# EasyEDA Pro project kuafu01_030内部老化方案.eprj, board PCB4 (continued)
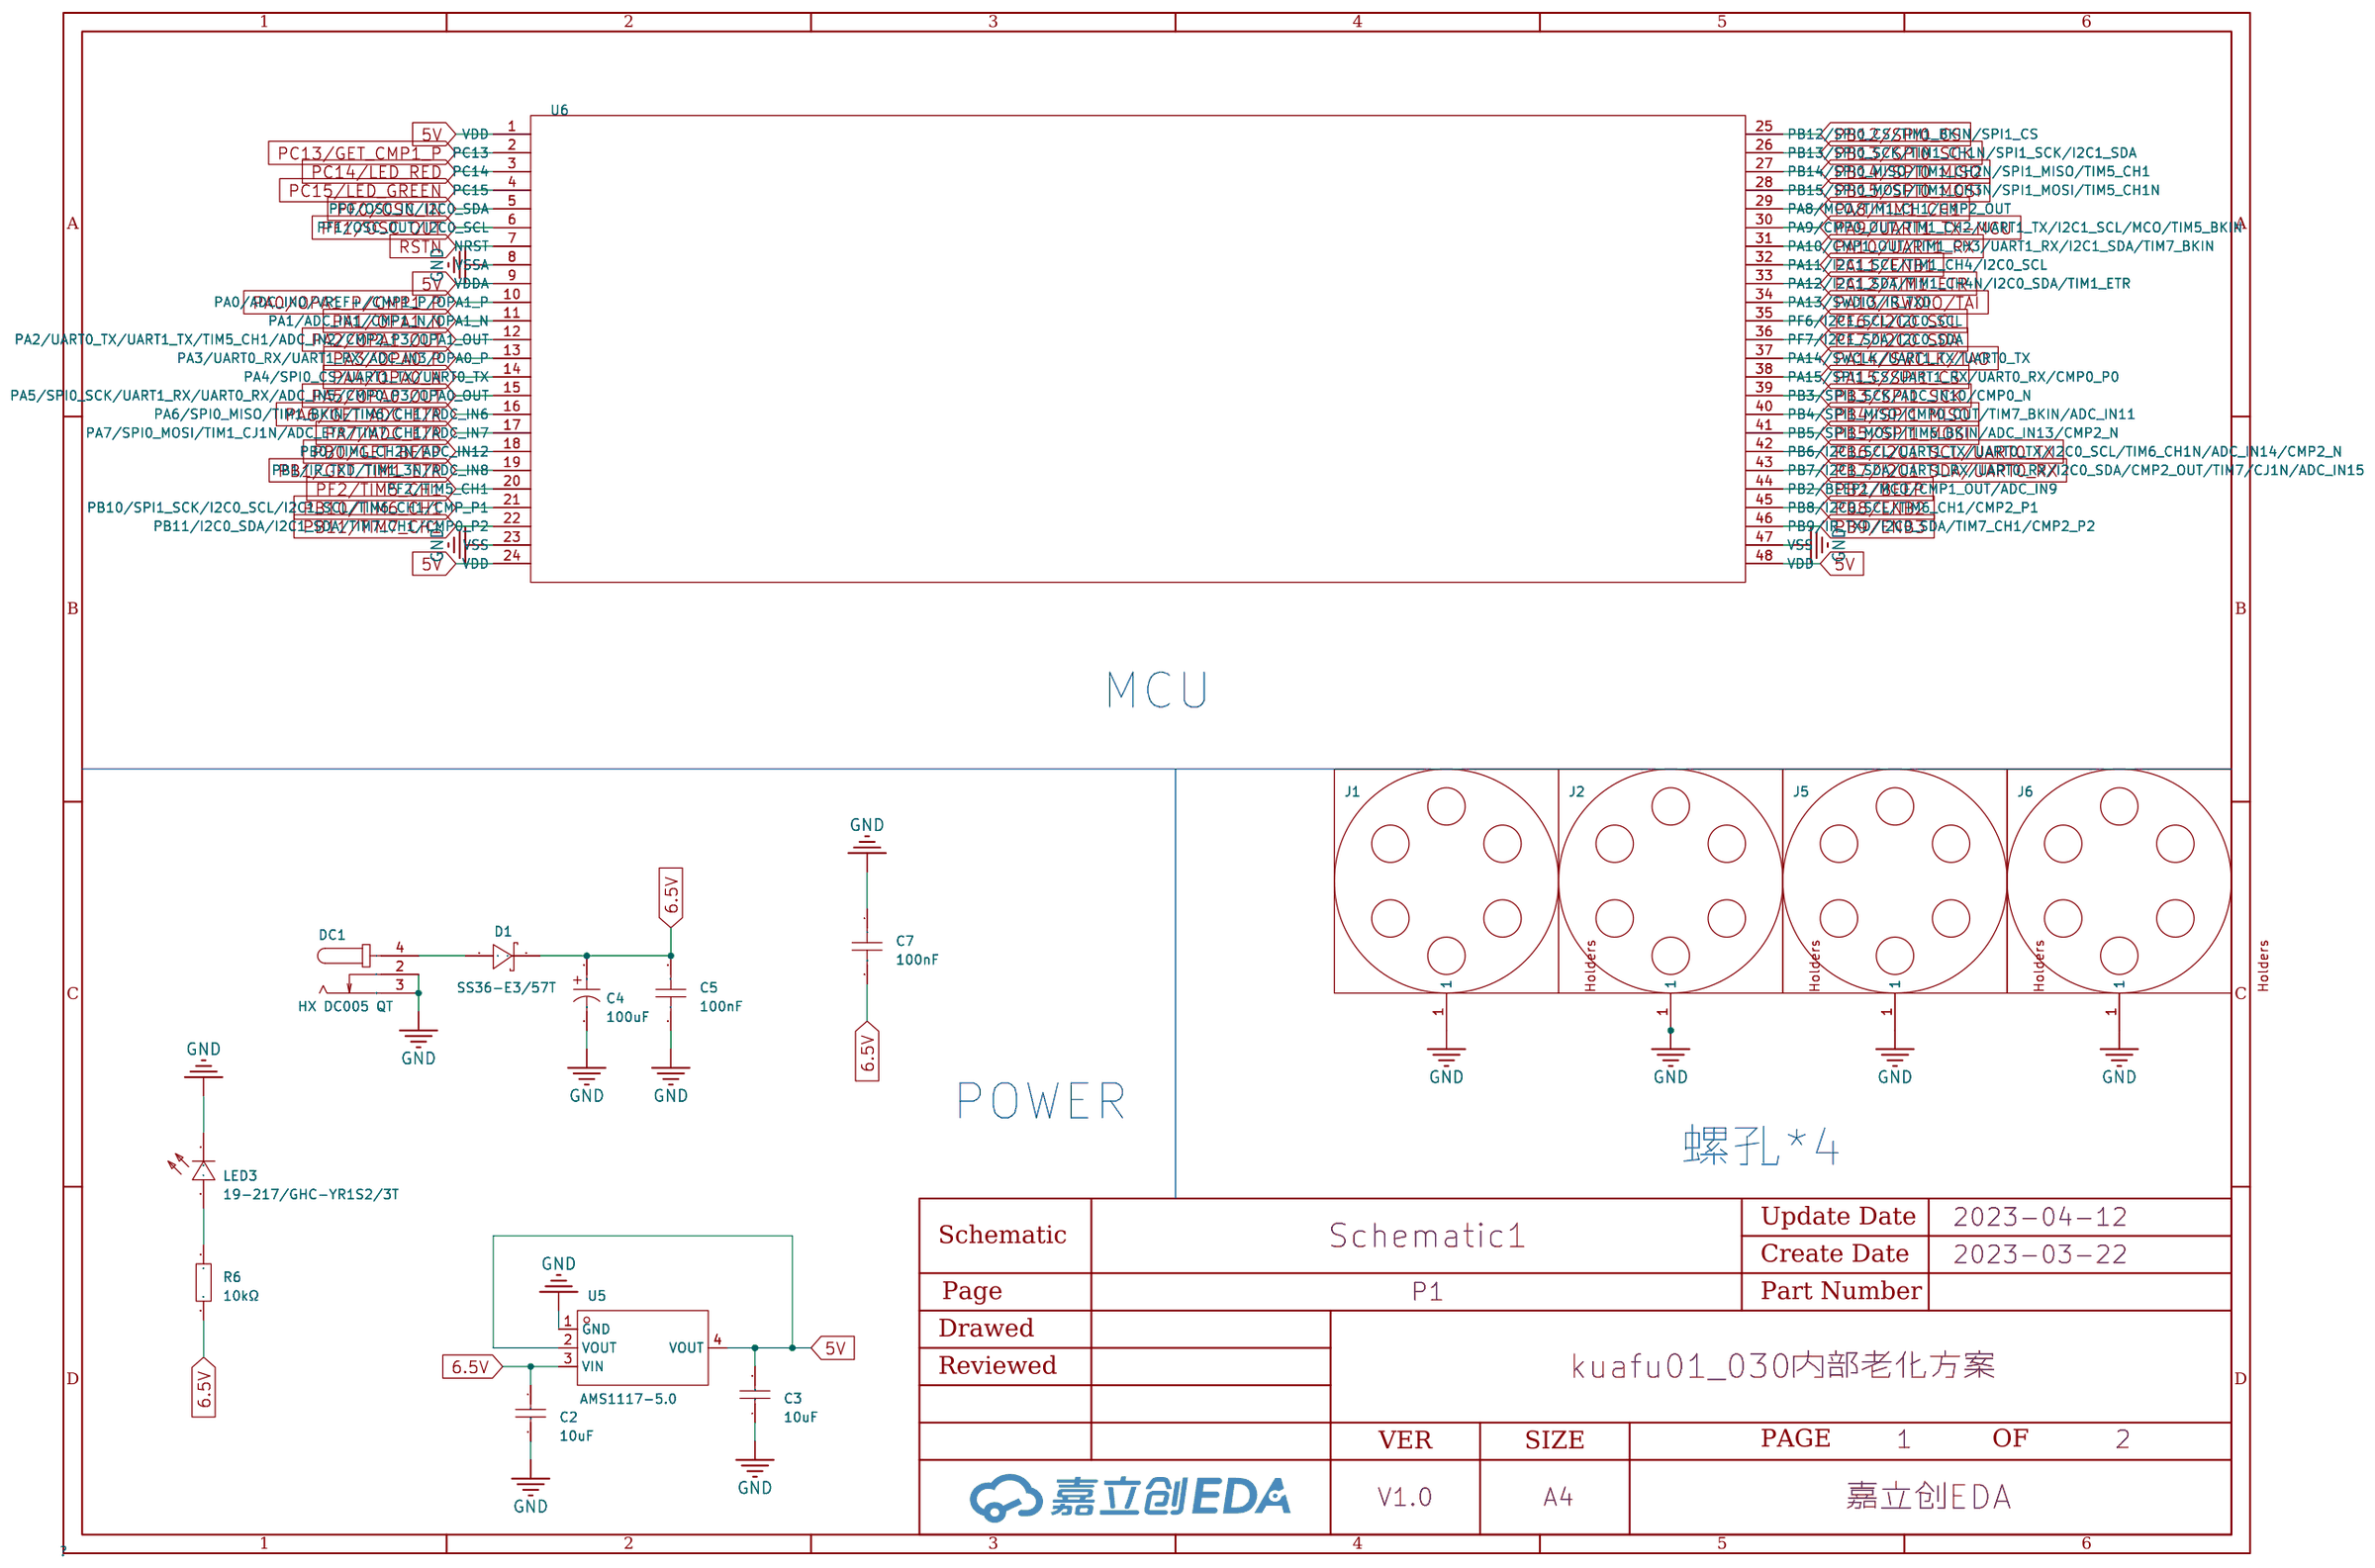
[diagram p0: P1]
## Nets (continued)
$1N1872: D1.1 DC1.4
$1N1886: LED3.2 R6.1
$4N6329: LED2.1 LED2#2.1 LED2#3.1 LED2#4.1 LED2#5.1 LED2#6.1 LED2#7.1 LED2#8.1 LED2#9.1 LED2#10.1 LED2#11.1 LED2#12.1 LED2#13.1 LED2#14.1 LED2#15.1 LED2#16.1 LED2#17.1 LED2#18.1 LED2#19.1 LED2#20.1 LED2#21.1 LED2#22.1 LED2#23.1 LED2#24.1 LED2#25.1 LED2#26.1 LED2#27.1 LED2#28.1 LED2#29.1 LED2#30.1 LED2#31.1 LED2#32.1 LED2#33.1 LED2#34.1 LED2#35.1 LED2#36.1 LED2#37.1 LED2#38.1 LED2#39.1 LED2#40.1 R2.2 R2#2.2 R2#3.2 R2#4.2 R2#5.2 R2#6.2 R2#7.2 R2#8.2 R2#9.2 R2#10.2 R2#11.2 R2#12.2 R2#13.2 R2#14.2 R2#15.2 R2#16.2 R2#17.2 R2#18.2 R2#19.2 R2#20.2 R2#21.2 R2#22.2 R2#23.2 R2#24.2 R2#25.2 R2#26.2 R2#27.2 R2#28.2 R2#29.2 R2#30.2 R2#31.2 R2#32.2 R2#33.2 R2#34.2 R2#35.2 R2#36.2 R2#37.2 R2#38.2 R2#39.2 R2#40.2
$4N6330: LED1.1 LED1#2.1 LED1#3.1 LED1#4.1 LED1#5.1 LED1#6.1 LED1#7.1 LED1#8.1 LED1#9.1 LED1#10.1 LED1#11.1 LED1#12.1 LED1#13.1 LED1#14.1 LED1#15.1 LED1#16.1 LED1#17.1 LED1#18.1 LED1#19.1 LED1#20.1 LED1#21.1 LED1#22.1 LED1#23.1 LED1#24.1 LED1#25.1 LED1#26.1 LED1#27.1 LED1#28.1 LED1#29.1 LED1#30.1 LED1#31.1 LED1#32.1 LED1#33.1 LED1#34.1 LED1#35.1 LED1#36.1 LED1#37.1 LED1#38.1 LED1#39.1 LED1#40.1 R1.2 R1#2.2 R1#3.2 R1#4.2 R1#5.2 R1#6.2 R1#7.2 R1#8.2 R1#9.2 R1#10.2 R1#11.2 R1#12.2 R1#13.2 R1#14.2 R1#15.2 R1#16.2 R1#17.2 R1#18.2 R1#19.2 R1#20.2 R1#21.2 R1#22.2 R1#23.2 R1#24.2 R1#25.2 R1#26.2 R1#27.2 R1#28.2 R1#29.2 R1#30.2 R1#31.2 R1#32.2 R1#33.2 R1#34.2 R1#35.2 R1#36.2 R1#37.2 R1#38.2 R1#39.2 R1#40.2

Pads without a net: U6 49; U6#2 49; U6#3 49; U6#4 49; U6#5 49; U6#6 49; U6#7 49; U6#8 49; U6#9 49; U6#10 49; U6#11 49; U6#12 49; U6#13 49; U6#14 49; U6#15 49; U6#16 49; U6#17 49; U6#18 49; U6#19 49; U6#20 49; U6#21 49; U6#22 49; U6#23 49; U6#24 49; U6#25 49; U6#26 49; U6#27 49; U6#28 49; U6#29 49; U6#30 49; U6#31 49; U6#32 49; U6#33 49; U6#34 49; U6#35 49; U6#36 49; U6#37 49; U6#38 49; U6#39 49; U6#40 49

## Via types
v1: diameter 0.61, hole 0.305, Top Layer to Bottom Layer, 8086 vias

## Routing (per net, layer and track width the routed paths; a pad name or vN(x,y) marks a point on that pad's centre or on a via; arc(x,y) is an arc through that point)
2.048V: length 887.5
  Top Layer w0.254: 250.36,223.31 252.09,225.05 252.09,225.91 ; 250.36,223.31 250.36,220.43 248.09,218.16 ; 250.36,223.31 247.61,223.31 247.57,223.27 ; 201.29,276.71 201.29,275.85 199.56,274.11 ; 137.86,172.49 137.86,173.3 138.81,174.24 144.3,174.24 145.95,172.6 ; 148.76,121.71 150.49,123.45 150.49,124.31 ; 148.76,121.71 148.76,118.83 146.49,116.56 ; 148.76,121.71 146.01,121.71 145.97,121.67 ; 252.09,175.11 252.09,174.25 250.36,172.51 ; 47.16,121.71 47.16,118.83 44.89,116.56 ; 47.16,121.71 44.41,121.71 44.37,121.67 ; 47.16,121.71 48.89,123.45 48.89,124.31 ; 252.09,327.51 252.09,326.65 250.36,324.91 ; 44.37,172.47 44.41,172.51 47.16,172.51 ; 87.06,324.89 87.06,325.7 88,326.64 93.5,326.64 95.15,325 ; 301.16,121.71 302.89,123.45 302.89,124.31 ; 301.16,121.71 298.41,121.71 298.37,121.67 ; 301.16,121.71 301.16,118.83 298.89,116.56 ; 250.36,70.91 247.61,70.91 247.57,70.87 ; 250.36,70.91 250.36,68.03 248.09,65.76 ; 250.36,70.91 252.09,72.65 252.09,73.51 ; 196.75,20.2 195.1,21.84 189.61,21.84 188.66,20.9 188.66,20.09 ; 44.35,121.8 42.7,123.44 37.2,123.44 36.26,122.5 36.26,121.69 ; 201.29,73.51 201.29,72.65 199.56,70.91 ; 87.06,274.09 87.06,274.9 88,275.84 93.5,275.84 95.15,274.2 ; 95.17,121.67 95.21,121.71 97.96,121.71 ; 247.57,172.47 247.61,172.51 250.36,172.51 ; 150.49,225.91 150.49,225.05 148.76,223.31 ; 197.29,268.96 199.56,271.23 199.56,274.11 ; 95.69,268.96 97.96,271.23 97.96,274.11 ; 298.35,274.2 296.7,275.84 291.2,275.84 290.26,274.9 290.26,274.09 ; 97.96,20.11 97.96,17.23 95.69,14.96 ; 97.96,20.11 99.69,21.85 99.69,22.71 ; 97.96,20.11 95.21,20.11 95.17,20.07 ; 97.96,70.91 97.96,68.03 95.69,65.76 ; 97.96,70.91 99.69,72.65 99.69,73.51 ; 97.96,70.91 95.21,70.91 95.17,70.87 ; 298.37,70.87 298.41,70.91 301.16,70.91 ; 148.76,70.91 146.01,70.91 145.97,70.87 ; 148.76,70.91 148.76,68.03 146.49,65.76 ; 148.76,70.91 150.49,72.65 150.49,73.51 ; 47.16,20.11 44.41,20.11 44.37,20.07 ; 47.16,20.11 48.89,21.85 48.89,22.71 ; 47.16,20.11 47.16,17.23 44.89,14.96 ; 44.35,71 42.7,72.64 37.2,72.64 36.26,71.7 36.26,70.89 ; 298.89,65.76 301.16,68.03 301.16,70.91 ; 290.26,70.89 290.26,71.7 291.2,72.64 296.7,72.64 298.35,71 ; 239.46,121.69 239.46,122.5 240.41,123.44 245.9,123.44 247.55,121.8 ; 302.89,175.11 302.89,174.25 301.16,172.51 ; 301.16,324.91 298.41,324.91 298.37,324.87 ; 301.16,324.91 302.89,326.65 302.89,327.51 ; 301.16,324.91 301.16,322.03 298.89,319.76 ; 196.75,71 195.1,72.64 189.61,72.64 188.66,71.7 188.66,70.89 ; 99.69,225.91 99.69,225.05 97.96,223.31 ; 201.29,225.91 201.29,225.05 199.56,223.31 ; 150.49,22.71 150.49,21.85 148.76,20.11 ; 44.37,70.87 44.41,70.91 47.16,70.91 ; 247.57,274.07 247.61,274.11 250.36,274.11 ; 145.95,223.4 144.3,225.04 138.81,225.04 137.86,224.1 137.86,223.29 ; 199.56,121.71 196.81,121.71 196.77,121.67 ; 199.56,121.71 201.29,123.45 201.29,124.31 ; 199.56,121.71 199.56,118.83 197.29,116.56 ; 150.49,175.11 150.49,174.25 148.76,172.51 ; 148.76,20.11 148.76,17.23 146.49,14.96 ; 148.76,20.11 146.01,20.11 145.97,20.07 ; 239.46,324.89 239.46,325.7 240.41,326.64 245.9,326.64 247.55,325 ; 188.66,324.89 188.66,325.7 189.61,326.64 195.1,326.64 196.75,325 ; 197.29,14.96 199.56,17.23 199.56,20.11 ; 148.76,274.11 150.49,275.85 150.49,276.71 ; 148.76,274.11 146.01,274.11 145.97,274.07 ; 148.76,274.11 148.76,271.23 146.49,268.96 ; 97.96,172.51 95.21,172.51 95.17,172.47 ; 97.96,172.51 97.96,169.63 95.69,167.36 ; 97.96,172.51 99.69,174.25 99.69,175.11 ; 301.16,223.31 301.16,220.43 298.89,218.16 ; 301.16,223.31 298.41,223.31 298.37,223.27 ; 301.16,223.31 302.89,225.05 302.89,225.91 ; 290.26,324.89 290.26,325.7 291.2,326.64 296.7,326.64 298.35,325 ; 47.16,172.51 47.16,169.63 44.89,167.36 ; 47.16,172.51 48.89,174.25 48.89,175.11 ; 199.56,324.91 196.81,324.91 196.77,324.87 ; 199.56,324.91 199.56,322.03 197.29,319.76 ; 199.56,324.91 201.29,326.65 201.29,327.51 ; 250.36,274.11 252.09,275.85 252.09,276.71 ; 250.36,274.11 250.36,271.23 248.09,268.96 ; 301.16,172.51 298.41,172.51 298.37,172.47 ; 301.16,172.51 301.16,169.63 298.89,167.36 ; 247.55,172.6 245.9,174.24 240.41,174.24 239.46,173.3 239.46,172.49 ; 146.49,218.16 148.76,220.43 148.76,223.31 ; 290.26,172.49 290.26,173.3 291.2,174.24 296.7,174.24 298.35,172.6 ; 97.96,274.11 95.21,274.11 95.17,274.07 ; 97.96,274.11 99.69,275.85 99.69,276.71 ; 97.96,121.71 97.96,118.83 95.69,116.56 ; 97.96,121.71 99.69,123.45 99.69,124.31 ; 87.06,121.69 87.06,122.5 88,123.44 93.5,123.44 95.15,121.8 ; 250.36,20.11 250.36,17.23 248.09,14.96 ; 250.36,20.11 247.61,20.11 247.57,20.07 ; 250.36,20.11 252.09,21.85 252.09,22.71 ; 248.09,167.36 250.36,169.63 250.36,172.51 ; 301.16,70.91 302.89,72.65 302.89,73.51 ; 188.66,223.29 188.66,224.1 189.61,225.04 195.1,225.04 196.75,223.4 ; 196.75,121.8 195.1,123.44 189.61,123.44 188.66,122.5 188.66,121.69 ; 248.09,116.56 250.36,118.83 250.36,121.71 ; 199.56,172.51 201.29,174.25 201.29,175.11 ; 199.56,172.51 196.81,172.51 196.77,172.47 ; 199.56,172.51 199.56,169.63 197.29,167.36 ; 197.29,65.76 199.56,68.03 199.56,70.91 ; 148.76,223.31 146.01,223.31 145.97,223.27 ; 250.36,121.71 247.61,121.71 247.57,121.67 ; 250.36,121.71 252.09,123.45 252.09,124.31 ; 188.66,172.49 188.66,173.3 189.61,174.24 195.1,174.24 196.75,172.6 ; 301.16,274.11 302.89,275.85 302.89,276.71 ; 301.16,274.11 298.41,274.11 298.37,274.07 ; 301.16,274.11 301.16,271.23 298.89,268.96 ; 196.77,223.27 196.81,223.31 199.56,223.31 ; 97.96,223.31 97.96,220.43 95.69,218.16 ; 97.96,223.31 95.21,223.31 95.17,223.27 ; 199.56,223.31 199.56,220.43 197.29,218.16 ; 97.96,324.91 99.69,326.65 99.69,327.51 ; 97.96,324.91 95.21,324.91 95.17,324.87 ; 97.96,324.91 97.96,322.03 95.69,319.76 ; 145.97,172.47 146.01,172.51 148.76,172.51 ; 44.89,218.16 47.16,220.43 47.16,223.31 ; 148.76,324.91 150.49,326.65 150.49,327.51 ; 148.76,324.91 146.01,324.91 145.97,324.87 ; 148.76,324.91 148.76,322.03 146.49,319.76 ; 47.16,70.91 48.89,72.65 48.89,73.51 ; 47.16,70.91 47.16,68.03 44.89,65.76 ; 95.15,172.6 93.5,174.24 88,174.24 87.06,173.3 87.06,172.49 ; 44.35,274.2 42.7,275.84 37.2,275.84 36.26,274.9 36.26,274.09 ; 247.55,274.2 245.9,275.84 240.41,275.84 239.46,274.9 239.46,274.09 ; 199.56,70.91 196.81,70.91 196.77,70.87 ; 47.16,274.11 48.89,275.85 48.89,276.71 ; 47.16,274.11 47.16,271.23 44.89,268.96 ; 47.16,274.11 44.41,274.11 44.37,274.07 ; 146.49,167.36 148.76,169.63 148.76,172.51 ; 250.36,324.91 250.36,322.03 248.09,319.76 ; 250.36,324.91 247.61,324.91 247.57,324.87 ; 199.56,274.11 196.81,274.11 196.77,274.07 ; 196.77,20.07 196.81,20.11 199.56,20.11 ; 87.06,20.09 87.06,20.9 88,21.84 93.5,21.84 95.15,20.2 ; 298.35,121.8 296.7,123.44 291.2,123.44 290.26,122.5 290.26,121.69 ; 247.55,223.4 245.9,225.04 240.41,225.04 239.46,224.1 239.46,223.29 ; 137.86,324.89 137.86,325.7 138.81,326.64 144.3,326.64 145.95,325 ; 145.95,121.8 144.3,123.44 138.81,123.44 137.86,122.5 137.86,121.69 ; 36.26,223.29 36.26,224.1 37.2,225.04 42.7,225.04 44.35,223.4 ; 47.16,223.31 48.89,225.05 48.89,225.91 ; 47.16,223.31 44.41,223.31 44.37,223.27 ; 95.15,71 93.5,72.64 88,72.64 87.06,71.7 87.06,70.89 ; 199.56,20.11 201.29,21.85 201.29,22.71 ; 298.35,223.4 296.7,225.04 291.2,225.04 290.26,224.1 290.26,223.29 ; 239.46,70.89 239.46,71.7 240.41,72.64 245.9,72.64 247.55,71 ; 145.95,20.2 144.3,21.84 138.81,21.84 137.86,20.9 137.86,20.09 ; 44.35,172.6 42.7,174.24 37.2,174.24 36.26,173.3 36.26,172.49 ; 137.86,274.09 137.86,274.9 138.81,275.84 144.3,275.84 145.95,274.2 ; 36.26,20.09 36.26,20.9 37.2,21.84 42.7,21.84 44.35,20.2 ; 247.55,20.2 245.9,21.84 240.41,21.84 239.46,20.9 239.46,20.09 ; 95.15,223.4 93.5,225.04 88,225.04 87.06,224.1 87.06,223.29 ; 188.66,274.09 188.66,274.9 189.61,275.84 195.1,275.84 196.75,274.2 ; 145.95,71 144.3,72.64 138.81,72.64 137.86,71.7 137.86,70.89
5V: length 9500
  Top Layer w0.381: 300.69,228.71 296.87,228.71 294.88,226.72 291.99,226.72 v1(291.42,226.14) ; 96.69,31.83 96.33,32.19 96.33,32.9 ; 96.69,31.83 95.2,31.83 93.57,33.46 v1(93.57,34.25) ; 96.69,31.83 97.62,30.9 ; 46.82,284.9 47.45,285.53 48.8,285.53 ; 46.82,284.9 45.89,285.83 ; 46.82,284.9 46.82,283.59 46.85,283.57 ; v1(189.82,73.74) 190.39,74.32 193.28,74.32 195.27,76.31 199.09,76.31 ; 96.69,82.63 96.33,82.99 96.33,83.7 ; 96.69,82.63 95.2,82.63 93.57,84.26 v1(93.57,85.05) ; 96.69,82.63 97.62,81.7 ; v1(245.97,34.25) 245.97,33.46 247.6,31.83 249.09,31.83 ; v1(139.02,22.94) 139.59,23.52 142.48,23.52 144.47,25.51 148.29,25.51 ; 299.53,83.7 299.53,82.99 299.89,82.63 ; 97.62,30.9 97.62,29.59 97.65,29.57 ; 97.62,30.9 98.25,31.53 99.6,31.53 ; v1(55.2,172.64) 54.39,173.45 54.39,174.97 ; v1(139.02,327.74) 139.59,328.32 142.48,328.32 144.47,330.31 148.29,330.31 ; 97.62,81.7 98.25,82.33 99.6,82.33 ; 97.62,81.7 97.62,80.39 97.65,80.37 ; 155.99,225.77 155.99,224.25 v1(156.8,223.44) ; v1(144.37,339.05) 144.37,338.26 146,336.63 147.49,336.63 ; 155.8,39 156.89,40.1 v1(156.92,40.1) ; 197.93,286.9 197.93,286.19 198.29,285.83 ; 299.89,133.43 300.82,132.5 ; 299.89,133.43 298.4,133.43 296.77,135.06 v1(296.77,135.85) ; 299.89,133.43 299.53,133.79 299.53,134.5 ; 300.82,132.5 301.45,133.13 302.8,133.13 ; 300.82,132.5 300.82,131.19 300.85,131.17 ; v1(156.8,121.84) 155.99,122.65 155.99,124.17 ; 148.45,29.57 148.42,29.59 148.42,30.9 ; 99.6,183.93 98.25,183.93 97.62,183.3 ; 96.69,285.83 95.2,285.83 93.57,287.46 v1(93.57,288.25) ; 96.69,285.83 96.33,286.19 96.33,286.9 ; 96.69,285.83 97.62,284.9 ; 299.89,235.03 298.4,235.03 296.77,236.66 v1(296.77,237.45) ; 299.89,235.03 300.82,234.1 ; 299.89,235.03 299.53,235.39 299.53,236.1 ; 96.69,184.23 96.33,184.59 96.33,185.3 ; 96.69,184.23 95.2,184.23 93.57,185.86 v1(93.57,186.65) ; 96.69,184.23 97.62,183.3 ; 199.22,234.1 199.22,232.79 199.25,232.77 ; 199.22,234.1 199.85,234.73 201.2,234.73 ; 199.22,234.1 198.29,235.03 ; 148.42,132.5 149.05,133.13 150.4,133.13 ; 148.42,132.5 148.42,131.19 148.45,131.17 ; 148.42,132.5 147.49,133.43 ; 45.89,82.63 46.82,81.7 ; 45.89,82.63 45.53,82.99 45.53,83.7 ; 45.89,82.63 44.4,82.63 42.77,84.26 v1(42.77,85.05) ; 46.82,81.7 47.45,82.33 48.8,82.33 ; 46.82,81.7 46.82,80.39 46.85,80.37 ; 96.33,134.5 96.33,133.79 96.69,133.43 ; v1(37.42,22.94) 37.99,23.52 40.88,23.52 42.87,25.51 46.69,25.51 ; 250.02,284.9 250.02,283.59 250.05,283.57 ; 250.02,284.9 249.09,285.83 ; 250.02,284.9 250.65,285.53 252,285.53 ; 147.49,82.63 148.42,81.7 ; 147.49,82.63 147.13,82.99 147.13,83.7 ; 147.49,82.63 146,82.63 144.37,84.26 v1(144.37,85.05) ; 148.42,81.7 148.42,80.39 148.45,80.37 ; 148.42,81.7 149.05,82.33 150.4,82.33 ; 257.4,89.8 258.49,90.9 v1(258.52,90.9) ; 147.49,285.83 147.13,286.19 147.13,286.9 ; 147.49,285.83 146,285.83 144.37,287.46 v1(144.37,288.25) ; 147.49,285.83 148.42,284.9 ; 147.49,31.83 147.13,32.19 147.13,32.9 ; 147.49,31.83 146,31.83 144.37,33.46 v1(144.37,34.25) ; 147.49,31.83 148.42,30.9 ; 249.89,177.91 246.07,177.91 244.08,175.92 241.19,175.92 v1(240.62,175.34) ; 155.8,191.4 156.89,192.5 v1(156.92,192.5) ; 300.82,81.7 300.82,80.39 300.85,80.37 ; 300.82,81.7 299.89,82.63 ; 300.82,81.7 301.45,82.33 302.8,82.33 ; 249.09,235.03 250.02,234.1 ; 249.09,235.03 248.73,235.39 248.73,236.1 ; 249.09,235.03 247.6,235.03 245.97,236.66 v1(245.97,237.45) ; 250.02,234.1 250.65,234.73 252,234.73 ; 250.02,234.1 250.02,232.79 250.05,232.77 ; v1(207.6,172.64) 206.79,173.45 206.79,174.97 ; 147.13,134.5 147.13,133.79 147.49,133.43 ; 198.29,285.83 199.22,284.9 ; 198.29,285.83 196.8,285.83 195.17,287.46 v1(195.17,288.25) ; 199.22,284.9 199.85,285.53 201.2,285.53 ; 199.22,284.9 199.22,283.59 199.25,283.57 ; 54.2,39 55.29,40.1 v1(55.32,40.1) ; 54.2,293 55.29,294.1 v1(55.32,294.1) ; 257.4,140.6 258.49,141.7 v1(258.52,141.7) ; v1(37.42,73.74) 37.99,74.32 40.88,74.32 42.87,76.31 46.69,76.31 ; v1(240.62,327.74) 241.19,328.32 244.08,328.32 246.07,330.31 249.89,330.31 ; 148.45,232.77 148.42,232.79 148.42,234.1 ; v1(55.32,141.7) 55.29,141.7 54.2,140.6 ; 211.57,132.42 210.83,132.42 210.09,133.16 v1(210.02,133.16) ; 160.77,132.42 160.03,132.42 159.29,133.16 v1(159.22,133.16) ; v1(195.17,237.45) 195.17,236.66 196.8,235.03 198.29,235.03 ; 257.59,73.37 257.59,71.85 v1(258.4,71.04) ; 198.29,336.63 196.8,336.63 195.17,338.26 v1(195.17,339.05) ; 198.29,336.63 199.22,335.7 ; 198.29,336.63 197.93,336.99 197.93,337.7 ; 249.09,336.63 248.73,336.99 248.73,337.7 ; 249.09,336.63 250.02,335.7 ; 249.09,336.63 247.6,336.63 245.97,338.26 v1(245.97,339.05) ; 199.22,132.5 199.85,133.13 201.2,133.13 ; 199.22,132.5 199.22,131.19 199.25,131.17 ; 199.22,132.5 198.29,133.43 ; 250.02,335.7 250.02,334.39 250.05,334.37 ; 250.02,335.7 250.65,336.33 252,336.33 ; 308.2,242.2 309.29,243.3 v1(309.32,243.3) ; 206.79,276.57 206.79,275.05 v1(207.6,274.24) ; 250.02,30.9 250.02,29.59 250.05,29.57 ; 250.02,30.9 250.65,31.53 252,31.53 ; 250.02,30.9 249.09,31.83 ; 46.82,132.5 46.82,131.19 46.85,131.17 ; 46.82,132.5 47.45,133.13 48.8,133.13 ; 46.82,132.5 45.89,133.43 ; 97.49,279.51 93.67,279.51 91.68,277.52 88.79,277.52 v1(88.22,276.94) ; v1(106.12,141.7) 106.09,141.7 105,140.6 ; 249.09,82.63 250.02,81.7 ; 249.09,82.63 248.73,82.99 248.73,83.7 ; 249.09,82.63 247.6,82.63 245.97,84.26 v1(245.97,85.05) ; 250.02,81.7 250.65,82.33 252,82.33 ; 250.02,81.7 250.02,80.39 250.05,80.37 ; 150.4,234.73 149.05,234.73 148.42,234.1 ; 257.4,293 258.49,294.1 v1(258.52,294.1) ; 48.8,31.53 47.45,31.53 46.82,30.9 ; v1(156.92,344.9) 156.89,344.9 155.8,343.8 ; 46.82,30.9 46.82,29.59 46.85,29.57 ; 46.82,30.9 45.89,31.83 ; 105.19,73.37 105.19,71.85 v1(106,71.04) ; 147.49,235.03 147.13,235.39 147.13,236.1 ; 147.49,235.03 148.42,234.1 ; 147.49,235.03 146,235.03 144.37,236.66 v1(144.37,237.45) ; 45.89,31.83 45.53,32.19 45.53,32.9 ; 45.89,31.83 44.4,31.83 42.77,33.46 v1(42.77,34.25) ; 97.65,232.77 97.62,232.79 97.62,234.1 ; 54.2,191.4 55.29,192.5 v1(55.32,192.5) ; v1(189.82,124.54) 190.39,125.12 193.28,125.12 195.27,127.11 199.09,127.11 ; 97.49,25.51 93.67,25.51 91.68,23.52 88.79,23.52 v1(88.22,22.94) ; 299.89,336.63 300.82,335.7 ; 299.89,336.63 298.4,336.63 296.77,338.26 v1(296.77,339.05) ; 299.89,336.63 299.53,336.99 299.53,337.7 ; 300.82,335.7 300.82,334.39 300.85,334.37 ; 300.82,335.7 301.45,336.33 302.8,336.33 ; v1(106,121.84) 105.19,122.65 105.19,124.17 ; v1(309.2,274.24) 308.39,275.05 308.39,276.57 ; v1(207.6,71.04) 206.79,71.85 206.79,73.37 ; v1(159.22,285.56) 159.29,285.56 160.03,284.82 160.77,284.82 ; v1(156.8,172.64) 155.99,173.45 155.99,174.97 ; 105,39 106.09,40.1 v1(106.12,40.1) ; 302.8,285.53 301.45,285.53 300.82,284.9 ; 262.37,30.82 261.63,30.82 260.89,31.56 v1(260.82,31.56) ; v1(258.4,20.24) 257.59,21.05 257.59,22.57 ; 109.97,81.62 109.23,81.62 108.49,82.36 v1(108.42,82.36) ; 46.82,183.3 46.82,181.99 46.85,181.97 ; 46.82,183.3 45.89,184.23 ; 46.82,183.3 47.45,183.93 48.8,183.93 ; 148.42,284.9 148.42,283.59 148.45,283.57 ; 148.42,284.9 149.05,285.53 150.4,285.53 ; v1(42.77,186.65) 42.77,185.86 44.4,184.23 45.89,184.23 ; v1(309.2,172.64) 308.39,173.45 308.39,174.97 ; 45.89,235.03 44.4,235.03 42.77,236.66 v1(42.77,237.45) ; 45.89,235.03 46.82,234.1 ; 45.89,235.03 45.53,235.39 45.53,236.1 ; v1(207.6,20.24) 206.79,21.05 206.79,22.57 ; v1(93.57,237.45) 93.57,236.66 95.2,235.03 96.69,235.03 ; v1(189.82,276.94) 190.39,277.52 193.28,277.52 195.27,279.51 199.09,279.51 ; 96.69,336.63 95.2,336.63 93.57,338.26 v1(93.57,339.05) ; 96.69,336.63 97.62,335.7 ; 96.69,336.63 96.33,336.99 96.33,337.7 ; 199.22,30.9 199.85,31.53 201.2,31.53 ; 199.22,30.9 199.22,29.59 199.25,29.57 ; 199.22,30.9 198.29,31.83 ; 147.49,184.23 148.42,183.3 ; 147.49,184.23 146,184.23 144.37,185.86 v1(144.37,186.65) ; 147.49,184.23 147.13,184.59 147.13,185.3 ; 148.42,183.3 149.05,183.93 150.4,183.93 ; 148.42,183.3 148.42,181.99 148.45,181.97 ; 46.69,279.51 42.87,279.51 40.88,277.52 37.99,277.52 v1(37.42,276.94) ; 249.09,285.83 247.6,285.83 245.97,287.46 v1(245.97,288.25) ; 249.09,285.83 248.73,286.19 248.73,286.9 ; 105,191.4 106.09,192.5 v1(106.12,192.5) ; v1(207.72,192.5) 207.69,192.5 206.6,191.4 ; 308.39,327.37 308.39,325.85 v1(309.2,325.04) ; v1(240.62,73.74) 241.19,74.32 244.08,74.32 246.07,76.31 249.89,76.31 ; 59.17,284.82 58.43,284.82 57.69,285.56 v1(57.62,285.56) ; v1(139.02,73.74) 139.59,74.32 142.48,74.32 144.47,76.31 148.29,76.31 ; v1(260.82,285.56) 260.89,285.56 261.63,284.82 262.37,284.82 ; 248.73,32.9 248.73,32.19 249.09,31.83 ; v1(311.62,183.96) 311.69,183.96 312.43,183.22 313.17,183.22 ; 105,293 106.09,294.1 v1(106.12,294.1) ; 250.02,183.3 250.02,181.99 250.05,181.97 ; 250.02,183.3 250.65,183.93 252,183.93 ; 250.02,183.3 249.09,184.23 ; v1(260.82,133.16) 260.89,133.16 261.63,132.42 262.37,132.42 ; 160.77,234.02 160.03,234.02 159.29,234.76 v1(159.22,234.76) ; v1(55.2,223.44) 54.39,224.25 54.39,225.77 ; v1(139.02,226.14) 139.59,226.72 142.48,226.72 144.47,228.71 148.29,228.71 ; v1(245.97,135.85) 245.97,135.06 247.6,133.43 249.09,133.43 ; 313.17,234.02 312.43,234.02 311.69,234.76 v1(311.62,234.76) ; 105,89.8 106.09,90.9 v1(106.12,90.9) ; v1(207.6,121.84) 206.79,122.65 206.79,124.17 ; v1(240.62,276.94) 241.19,277.52 244.08,277.52 246.07,279.51 249.89,279.51 ; 105.19,327.37 105.19,325.85 v1(106,325.04) ; 197.93,236.1 197.93,235.39 198.29,235.03 ; 206.6,242.2 207.69,243.3 v1(207.72,243.3) ; 313.17,284.82 312.43,284.82 311.69,285.56 v1(311.62,285.56) ; 155.99,276.57 155.99,275.05 v1(156.8,274.24) ; v1(207.72,141.7) 207.69,141.7 206.6,140.6 ; v1(156.8,71.04) 155.99,71.85 155.99,73.37 ; v1(291.42,73.74) 291.99,74.32 294.88,74.32 296.87,76.31 300.69,76.31 ; 198.29,184.23 197.93,184.59 197.93,185.3 ; 198.29,184.23 199.22,183.3 ; 198.29,184.23 196.8,184.23 195.17,185.86 v1(195.17,186.65) ; 300.69,330.31 296.87,330.31 294.88,328.32 291.99,328.32 v1(291.42,327.74) ; 300.82,284.9 300.82,283.59 300.85,283.57 ; 300.82,284.9 299.89,285.83 ; v1(291.42,276.94) 291.99,277.52 294.88,277.52 296.87,279.51 300.69,279.51 ; 45.89,133.43 45.53,133.79 45.53,134.5 ; 45.89,133.43 44.4,133.43 42.77,135.06 v1(42.77,135.85) ; 249.89,25.51 246.07,25.51 244.08,23.52 241.19,23.52 v1(240.62,22.94) ; 97.62,284.9 98.25,285.53 99.6,285.53 ; 97.62,284.9 97.62,283.59 97.65,283.57 ; v1(210.02,183.96) 210.09,183.96 210.83,183.22 211.57,183.22 ; 299.89,285.83 299.53,286.19 299.53,286.9 ; 299.89,285.83 298.4,285.83 296.77,287.46 v1(296.77,288.25) ; v1(156.8,20.24) 155.99,21.05 155.99,22.57 ; v1(260.82,82.36) 260.89,82.36 261.63,81.62 262.37,81.62 ; 300.82,234.1 300.82,232.79 300.85,232.77 ; 300.82,234.1 301.45,234.73 302.8,234.73 ; 257.4,242.2 258.49,243.3 v1(258.52,243.3) ; v1(106,172.64) 105.19,173.45 105.19,174.97 ; 45.89,285.83 44.4,285.83 42.77,287.46 v1(42.77,288.25) ; 45.89,285.83 45.53,286.19 45.53,286.9 ; 97.49,76.31 93.67,76.31 91.68,74.32 88.79,74.32 v1(88.22,73.74) ; 257.59,276.57 257.59,275.05 v1(258.4,274.24) ; v1(57.62,234.76) 57.69,234.76 58.43,234.02 59.17,234.02 ; 97.62,234.1 98.25,234.73 99.6,234.73 ; 97.62,234.1 96.69,235.03 ; 147.13,337.7 147.13,336.99 147.49,336.63 ; 59.17,81.62 58.43,81.62 57.69,82.36 v1(57.62,82.36) ; 299.89,184.23 299.53,184.59 299.53,185.3 ; 299.89,184.23 300.82,183.3 ; 299.89,184.23 298.4,184.23 296.77,185.86 v1(296.77,186.65) ; 257.59,124.17 257.59,122.65 v1(258.4,121.84) ; 105.19,22.57 105.19,21.05 v1(106,20.24) ; 257.59,174.97 257.59,173.45 v1(258.4,172.64) ; v1(189.82,175.34) 190.39,175.92 193.28,175.92 195.27,177.91 199.09,177.91 ; 198.29,82.63 199.22,81.7 ; 198.29,82.63 196.8,82.63 195.17,84.26 v1(195.17,85.05) ; 198.29,82.63 197.93,82.99 197.93,83.7 ; 199.22,81.7 199.22,80.39 199.25,80.37 ; 199.22,81.7 199.85,82.33 201.2,82.33 ; 45.89,184.23 45.53,184.59 45.53,185.3 ; 59.17,30.82 58.43,30.82 57.69,31.56 v1(57.62,31.56) ; v1(309.32,294.1) 309.29,294.1 308.2,293 ; v1(311.62,82.36) 311.69,82.36 312.43,81.62 313.17,81.62 ; 206.79,327.37 206.79,325.85 v1(207.6,325.04) ; v1(309.32,344.9) 309.29,344.9 308.2,343.8 ; 198.29,31.83 197.93,32.19 197.93,32.9 ; 198.29,31.83 196.8,31.83 195.17,33.46 v1(195.17,34.25) ; v1(88.22,175.34) 88.79,175.92 91.68,175.92 93.67,177.91 97.49,177.91 ; 299.89,82.63 298.4,82.63 296.77,84.26 v1(296.77,85.05) ; 48.8,234.73 47.45,234.73 46.82,234.1 ; 199.22,183.3 199.22,181.99 199.25,181.97 ; 199.22,183.3 199.85,183.93 201.2,183.93 ; 46.69,177.91 42.87,177.91 40.88,175.92 37.99,175.92 v1(37.42,175.34) ; 308.39,73.37 308.39,71.85 v1(309.2,71.04) ; v1(106,274.24) 105.19,275.05 105.19,276.57 ; 109.97,335.62 109.23,335.62 108.49,336.36 v1(108.42,336.36) ; 257.4,343.8 258.49,344.9 v1(258.52,344.9) ; 262.37,183.22 261.63,183.22 260.89,183.96 v1(260.82,183.96) ; 54.39,276.57 54.39,275.05 v1(55.2,274.24) ; v1(311.62,336.36) 311.69,336.36 312.43,335.62 313.17,335.62 ; 257.59,225.77 257.59,224.25 v1(258.4,223.44) ; v1(57.62,133.16) 57.69,133.16 58.43,132.42 59.17,132.42 ; 109.97,30.82 109.23,30.82 108.49,31.56 v1(108.42,31.56) ; 147.49,133.43 146,133.43 144.37,135.06 v1(144.37,135.85) ; v1(240.62,226.14) 241.19,226.72 244.08,226.72 246.07,228.71 249.89,228.71 ; 109.97,183.22 109.23,183.22 108.49,183.96 v1(108.42,183.96) ; v1(245.97,186.65) 245.97,185.86 247.6,184.23 249.09,184.23 ; 155.99,327.37 155.99,325.85 v1(156.8,325.04) ; 160.77,30.82 160.03,30.82 159.29,31.56 v1(159.22,31.56) ; v1(210.02,82.36) 210.09,82.36 210.83,81.62 211.57,81.62 ; 46.69,127.11 42.87,127.11 40.88,125.12 37.99,125.12 v1(37.42,124.54) ; 197.93,134.5 197.93,133.79 198.29,133.43 ; 199.25,334.37 199.22,334.39 199.22,335.7 ; 249.09,133.43 250.02,132.5 ; 249.09,133.43 248.73,133.79 248.73,134.5 ; v1(207.6,223.44) 206.79,224.25 206.79,225.77 ; v1(210.02,234.76) 210.09,234.76 210.83,234.02 211.57,234.02 ; 46.82,234.1 46.82,232.79 46.85,232.77 ; 252,133.13 250.65,133.13 250.02,132.5 ; v1(189.82,22.94) 190.39,23.52 193.28,23.52 195.27,25.51 199.09,25.51 ; 46.69,228.71 42.87,228.71 40.88,226.72 37.99,226.72 v1(37.42,226.14) ; v1(260.82,234.76) 260.89,234.76 261.63,234.02 262.37,234.02 ; 262.37,335.62 261.63,335.62 260.89,336.36 v1(260.82,336.36) ; 54.39,73.37 54.39,71.85 v1(55.2,71.04) ; 96.69,133.43 97.62,132.5 ; 96.69,133.43 95.2,133.43 93.57,135.06 v1(93.57,135.85) ; 97.62,132.5 97.62,131.19 97.65,131.17 ; 97.62,132.5 98.25,133.13 99.6,133.13 ; v1(291.42,175.34) 291.99,175.92 294.88,175.92 296.87,177.91 300.69,177.91 ; 105,242.2 106.09,243.3 v1(106.12,243.3) ; v1(55.32,243.3) 55.29,243.3 54.2,242.2 ; 109.97,284.82 109.23,284.82 108.49,285.56 v1(108.42,285.56) ; 250.02,132.5 250.02,131.19 250.05,131.17 ; 308.2,191.4 309.29,192.5 v1(309.32,192.5) ; v1(55.32,90.9) 55.29,90.9 54.2,89.8 ; 199.22,335.7 199.85,336.33 201.2,336.33 ; 150.4,31.53 149.05,31.53 148.42,30.9 ; 97.62,335.7 98.25,336.33 99.6,336.33 ; 97.62,335.7 97.62,334.39 97.65,334.37 ; 313.17,132.42 312.43,132.42 311.69,133.16 v1(311.62,133.16) ; 308.2,140.6 309.29,141.7 v1(309.32,141.7) ; 199.09,330.31 195.27,330.31 193.28,328.32 190.39,328.32 v1(189.82,327.74) ; 97.49,228.71 93.67,228.71 91.68,226.72 88.79,226.72 v1(88.22,226.14) ; 109.97,234.02 109.23,234.02 108.49,234.76 v1(108.42,234.76) ; 148.45,334.37 148.42,334.39 148.42,335.7 ; 97.65,181.97 97.62,181.99 97.62,183.3 ; v1(291.42,124.54) 291.99,125.12 294.88,125.12 296.87,127.11 300.69,127.11 ; v1(207.72,294.1) 207.69,294.1 206.6,293 ; 211.57,335.62 210.83,335.62 210.09,336.36 v1(210.02,336.36) ; 248.73,185.3 248.73,184.59 249.09,184.23 ; 147.49,336.63 148.42,335.7 ; 148.42,335.7 149.05,336.33 150.4,336.33 ; 160.77,81.62 160.03,81.62 159.29,82.36 v1(159.22,82.36) ; 155.8,140.6 156.89,141.7 v1(156.92,141.7) ; 97.49,127.11 93.67,127.11 91.68,125.12 88.79,125.12 v1(88.22,124.54) ; v1(156.92,243.3) 156.89,243.3 155.8,242.2 ; 300.82,183.3 301.45,183.93 302.8,183.93 ; 300.82,183.3 300.82,181.99 300.85,181.97 ; 105,343.8 106.09,344.9 v1(106.12,344.9) ; v1(258.4,325.04) 257.59,325.85 257.59,327.37 ; v1(156.92,90.9) 156.89,90.9 155.8,89.8 ; 257.4,39 258.49,40.1 v1(258.52,40.1) ; 211.57,284.82 210.83,284.82 210.09,285.56 v1(210.02,285.56) ; v1(88.22,327.74) 88.79,328.32 91.68,328.32 93.67,330.31 97.49,330.31 ; 206.6,89.8 207.69,90.9 v1(207.72,90.9) ; 198.29,133.43 196.8,133.43 195.17,135.06 v1(195.17,135.85) ; v1(106,223.44) 105.19,224.25 105.19,225.77 ; 308.39,225.77 308.39,224.25 v1(309.2,223.44) ; 109.97,132.42 109.23,132.42 108.49,133.16 v1(108.42,133.16) ; 206.6,39 207.69,40.1 v1(207.72,40.1) ; v1(207.72,344.9) 207.69,344.9 206.6,343.8 ; 199.09,228.71 195.27,228.71 193.28,226.72 190.39,226.72 v1(189.82,226.14) ; 160.77,335.62 160.03,335.62 159.29,336.36 v1(159.22,336.36) ; 59.17,183.22 58.43,183.22 57.69,183.96 v1(57.62,183.96) ; 257.4,191.4 258.49,192.5 v1(258.52,192.5) ; 308.2,89.8 309.29,90.9 v1(309.32,90.9) ; 148.29,177.91 144.47,177.91 142.48,175.92 139.59,175.92 v1(139.02,175.34) ; 148.29,279.51 144.47,279.51 142.48,277.52 139.59,277.52 v1(139.02,276.94) ; v1(156.92,294.1) 156.89,294.1 155.8,293 ; 148.29,127.11 144.47,127.11 142.48,125.12 139.59,125.12 v1(139.02,124.54) ; 96.69,235.03 96.33,235.39 96.33,236.1 ; v1(55.2,121.84) 54.39,122.65 54.39,124.17 ; v1(55.2,20.24) 54.39,21.05 54.39,22.57 ; 249.89,127.11 246.07,127.11 244.08,125.12 241.19,125.12 v1(240.62,124.54) ; 308.39,124.17 308.39,122.65 v1(309.2,121.84) ; v1(210.02,31.56) 210.09,31.56 210.83,30.82 211.57,30.82 ; 160.77,183.22 160.03,183.22 159.29,183.96 v1(159.22,183.96)